# EAGLE schematic Resistor_Resistor (EAGLE 8.3.0), part 21 of 43
## Parts (continued)
R28698  10K  RESISTOR_0201  [0201]
R28699  10K  RESISTOR_0201  [0201]
R28700  10K  RESISTOR_0201  [0201]
R28701  10K  RESISTOR_0201  [0201]
R28702  10K  RESISTOR_0201  [0201]
R28703  10K  RESISTOR_0201  [0201]
R28704  10K  RESISTOR_0201  [0201]
R28705  10K  RESISTOR_0201  [0201]
R28706  10K  RESISTOR_0201  [0201]
R28707  10K  RESISTOR_0201  [0201]
R28708  10K  RESISTOR_0201  [0201]
R28709  10K  RESISTOR_0201  [0201]
R28710  10K  RESISTOR_0201  [0201]
R28711  10K  RESISTOR_0201  [0201]
R28712  10K  RESISTOR_0201  [0201]
R28713  10K  RESISTOR_0201  [0201]
R28714  10K  RESISTOR_0201  [0201]
R28715  10K  RESISTOR_0201  [0201]
R28716  10K  RESISTOR_0201  [0201]
R28717  10K  RESISTOR_0201  [0201]
R28718  10K  RESISTOR_0201  [0201]
R28719  10K  RESISTOR_0201  [0201]
R28720  10K  RESISTOR_0201  [0201]
R28721  10K  RESISTOR_0201  [0201]
R28722  10K  RESISTOR_0201  [0201]
R28723  10K  RESISTOR_0201  [0201]
R28724  10K  RESISTOR_0201  [0201]
R28725  10K  RESISTOR_0201  [0201]
R28726  10K  RESISTOR_0201  [0201]
R28727  10K  RESISTOR_0201  [0201]
R28728  10K  RESISTOR_0201  [0201]
R28729  10K  RESISTOR_0201  [0201]
R28730  10K  RESISTOR_0201  [0201]
R28731  10K  RESISTOR_0201  [0201]
R28732  10K  RESISTOR_0201  [0201]
R28733  10K  RESISTOR_0201  [0201]
R28734  10K  RESISTOR_0201  [0201]
R28735  10K  RESISTOR_0201  [0201]
R28736  10K  RESISTOR_0201  [0201]
R28737  10K  RESISTOR_0201  [0201]
R28738  10K  RESISTOR_0201  [0201]
R28739  10K  RESISTOR_0201  [0201]
R28740  10K  RESISTOR_0201  [0201]
R28741  10K  RESISTOR_0201  [0201]
R28742  10K  RESISTOR_0201  [0201]
R28743  10K  RESISTOR_0201  [0201]
R28744  10K  RESISTOR_0201  [0201]
R28745  10K  RESISTOR_0201  [0201]
R28746  10K  RESISTOR_0201  [0201]
R28747  10K  RESISTOR_0201  [0201]
R28748  10K  RESISTOR_0201  [0201]
R28749  10K  RESISTOR_0201  [0201]
R28750  10K  RESISTOR_0201  [0201]
R28751  10K  RESISTOR_0201  [0201]
R28752  10K  RESISTOR_0201  [0201]
R28753  10K  RESISTOR_0201  [0201]
R28754  10K  RESISTOR_0201  [0201]
R28755  10K  RESISTOR_0201  [0201]
R28756  10K  RESISTOR_0201  [0201]
R28757  10K  RESISTOR_0201  [0201]
R28758  10K  RESISTOR_0201  [0201]
R28759  10K  RESISTOR_0201  [0201]
R28760  10K  RESISTOR_0201  [0201]
R28761  10K  RESISTOR_0201  [0201]
R28762  10K  RESISTOR_0201  [0201]
R28763  10K  RESISTOR_0201  [0201]
R28764  10K  RESISTOR_0201  [0201]
R28765  10K  RESISTOR_0201  [0201]
R28766  10K  RESISTOR_0201  [0201]
R28767  10K  RESISTOR_0201  [0201]
R28768  10K  RESISTOR_0201  [0201]
R28769  10K  RESISTOR_0201  [0201]
R28770  10K  RESISTOR_0201  [0201]
R28771  10K  RESISTOR_0201  [0201]
R28772  10K  RESISTOR_0201  [0201]
R28773  10K  RESISTOR_0201  [0201]
R28774  10K  RESISTOR_0201  [0201]
R28775  10K  RESISTOR_0201  [0201]
R28776  10K  RESISTOR_0201  [0201]
R28777  10K  RESISTOR_0201  [0201]
R28778  10K  RESISTOR_0201  [0201]
R28779  10K  RESISTOR_0201  [0201]
R28780  10K  RESISTOR_0201  [0201]
R28781  10K  RESISTOR_0201  [0201]
R28782  10K  RESISTOR_0201  [0201]
R28783  10K  RESISTOR_0201  [0201]
R28784  10K  RESISTOR_0201  [0201]
R28785  10K  RESISTOR_0201  [0201]
R28786  10K  RESISTOR_0201  [0201]
R28787  10K  RESISTOR_0201  [0201]
R28788  10K  RESISTOR_0201  [0201]
R28789  10K  RESISTOR_0201  [0201]
R28790  10K  RESISTOR_0201  [0201]
R28791  10K  RESISTOR_0201  [0201]
R28792  10K  RESISTOR_0201  [0201]
R28793  10K  RESISTOR_0201  [0201]
R28794  10K  RESISTOR_0201  [0201]
R28795  10K  RESISTOR_0201  [0201]
R28796  10K  RESISTOR_0201  [0201]
R28797  10K  RESISTOR_0201  [0201]
R28798  10K  RESISTOR_0201  [0201]
R28799  10K  RESISTOR_0201  [0201]
R28800  10K  RESISTOR_0201  [0201]
R28801  10K  RESISTOR_0201  [0201]
R28802  10K  RESISTOR_0201  [0201]
R28803  10K  RESISTOR_0201  [0201]
R28804  10K  RESISTOR_0201  [0201]
R28805  10K  RESISTOR_0201  [0201]
R28806  10K  RESISTOR_0201  [0201]
R28807  10K  RESISTOR_0201  [0201]
R28808  10K  RESISTOR_0201  [0201]
R28809  10K  RESISTOR_0201  [0201]
R28810  10K  RESISTOR_0201  [0201]
R28811  10K  RESISTOR_0201  [0201]
R28812  10K  RESISTOR_0201  [0201]
R28813  10K  RESISTOR_0201  [0201]
R28814  10K  RESISTOR_0201  [0201]
R28815  10K  RESISTOR_0201  [0201]
R28816  10K  RESISTOR_0201  [0201]
R28817  10K  RESISTOR_0201  [0201]
R28818  10K  RESISTOR_0201  [0201]
R28819  10K  RESISTOR_0201  [0201]
R28820  10K  RESISTOR_0201  [0201]
R28821  10K  RESISTOR_0201  [0201]
R28822  10K  RESISTOR_0201  [0201]
R28823  10K  RESISTOR_0201  [0201]
R28824  10K  RESISTOR_0201  [0201]
R28825  10K  RESISTOR_0201  [0201]
R28826  10K  RESISTOR_0201  [0201]
R28827  10K  RESISTOR_0201  [0201]
R28828  10K  RESISTOR_0201  [0201]
R28829  10K  RESISTOR_0201  [0201]
R28830  10K  RESISTOR_0201  [0201]
R28831  10K  RESISTOR_0201  [0201]
R28832  10K  RESISTOR_0201  [0201]
R28833  10K  RESISTOR_0201  [0201]
R28834  10K  RESISTOR_0201  [0201]
R28835  10K  RESISTOR_0201  [0201]
R28836  10K  RESISTOR_0201  [0201]
R28837  10K  RESISTOR_0201  [0201]
R28838  10K  RESISTOR_0201  [0201]
R28839  10K  RESISTOR_0201  [0201]
R28840  10K  RESISTOR_0201  [0201]
R28841  10K  RESISTOR_0201  [0201]
R28842  10K  RESISTOR_0201  [0201]
R28843  10K  RESISTOR_0201  [0201]
R28844  10K  RESISTOR_0201  [0201]
R28845  10K  RESISTOR_0201  [0201]
R28846  10K  RESISTOR_0201  [0201]
R28847  10K  RESISTOR_0201  [0201]
R28848  10K  RESISTOR_0201  [0201]
R28849  10K  RESISTOR_0201  [0201]
R28850  10K  RESISTOR_0201  [0201]
R28851  10K  RESISTOR_0201  [0201]
R28852  10K  RESISTOR_0201  [0201]
R28853  10K  RESISTOR_0201  [0201]
R28854  10K  RESISTOR_0201  [0201]
R28855  10K  RESISTOR_0201  [0201]
R28856  10K  RESISTOR_0201  [0201]
R28857  10K  RESISTOR_0201  [0201]
R28858  10K  RESISTOR_0201  [0201]
R28859  10K  RESISTOR_0201  [0201]
R28860  10K  RESISTOR_0201  [0201]
R28861  10K  RESISTOR_0201  [0201]
R28862  10K  RESISTOR_0201  [0201]
R28863  10K  RESISTOR_0201  [0201]
R28864  10K  RESISTOR_0201  [0201]
R28865  10K  RESISTOR_0201  [0201]
R28866  10K  RESISTOR_0201  [0201]
R28867  10K  RESISTOR_0201  [0201]
R28868  10K  RESISTOR_0201  [0201]
R28869  10K  RESISTOR_0201  [0201]
R28870  10K  RESISTOR_0201  [0201]
R28871  10K  RESISTOR_0201  [0201]
R28872  10K  RESISTOR_0201  [0201]
R28873  10K  RESISTOR_0201  [0201]
R28874  10K  RESISTOR_0201  [0201]
R28875  10K  RESISTOR_0201  [0201]
R28876  10K  RESISTOR_0201  [0201]
R28877  10K  RESISTOR_0201  [0201]
R28878  10K  RESISTOR_0201  [0201]
R28879  10K  RESISTOR_0201  [0201]
R28880  10K  RESISTOR_0201  [0201]
R28881  10K  RESISTOR_0201  [0201]
R28882  10K  RESISTOR_0201  [0201]
R28883  10K  RESISTOR_0201  [0201]
R28884  10K  RESISTOR_0201  [0201]
R28885  10K  RESISTOR_0201  [0201]
R28886  10K  RESISTOR_0201  [0201]
R28887  10K  RESISTOR_0201  [0201]
R28888  10K  RESISTOR_0201  [0201]
R28889  10K  RESISTOR_0201  [0201]
R28890  10K  RESISTOR_0201  [0201]
R28891  10K  RESISTOR_0201  [0201]
R28892  10K  RESISTOR_0201  [0201]
R28893  10K  RESISTOR_0201  [0201]
R28894  10K  RESISTOR_0201  [0201]
R28895  10K  RESISTOR_0201  [0201]
R28896  10K  RESISTOR_0201  [0201]
R28897  10K  RESISTOR_0201  [0201]
R28898  10K  RESISTOR_0201  [0201]
R28899  10K  RESISTOR_0201  [0201]
R28900  10K  RESISTOR_0201  [0201]
R28901  10K  RESISTOR_0201  [0201]
R28902  10K  RESISTOR_0201  [0201]
R28903  10K  RESISTOR_0201  [0201]
R28904  10K  RESISTOR_0201  [0201]
R28905  10K  RESISTOR_0201  [0201]
R28906  10K  RESISTOR_0201  [0201]
R28907  10K  RESISTOR_0201  [0201]
R28908  10K  RESISTOR_0201  [0201]
R28909  10K  RESISTOR_0201  [0201]
R28910  10K  RESISTOR_0201  [0201]
R28911  10K  RESISTOR_0201  [0201]
R28912  10K  RESISTOR_0201  [0201]
R28913  10K  RESISTOR_0201  [0201]
R28914  10K  RESISTOR_0201  [0201]
R28915  10K  RESISTOR_0201  [0201]
R28916  10K  RESISTOR_0201  [0201]
R28917  10K  RESISTOR_0201  [0201]
R28918  10K  RESISTOR_0201  [0201]
R28919  10K  RESISTOR_0201  [0201]
R28920  10K  RESISTOR_0201  [0201]
R28921  10K  RESISTOR_0201  [0201]
R28922  10K  RESISTOR_0201  [0201]
R28923  10K  RESISTOR_0201  [0201]
R28924  10K  RESISTOR_0201  [0201]
R28925  10K  RESISTOR_0201  [0201]
R28926  10K  RESISTOR_0201  [0201]
R28927  10K  RESISTOR_0201  [0201]
R28928  10K  RESISTOR_0201  [0201]
R28929  10K  RESISTOR_0201  [0201]
R28930  10K  RESISTOR_0201  [0201]
R28931  10K  RESISTOR_0201  [0201]
R28932  10K  RESISTOR_0201  [0201]
R28933  10K  RESISTOR_0201  [0201]
R28934  10K  RESISTOR_0201  [0201]
R28935  10K  RESISTOR_0201  [0201]
R28936  10K  RESISTOR_0201  [0201]
R28937  10K  RESISTOR_0201  [0201]
R28938  10K  RESISTOR_0201  [0201]
R28939  10K  RESISTOR_0201  [0201]
R28940  10K  RESISTOR_0201  [0201]
R28941  10K  RESISTOR_0201  [0201]
R28942  10K  RESISTOR_0201  [0201]
R28943  10K  RESISTOR_0201  [0201]
R28944  10K  RESISTOR_0201  [0201]
R28945  10K  RESISTOR_0201  [0201]
R28946  10K  RESISTOR_0201  [0201]
R28947  10K  RESISTOR_0201  [0201]
R28948  10K  RESISTOR_0201  [0201]
R28949  10K  RESISTOR_0201  [0201]
R28950  10K  RESISTOR_0201  [0201]
R28951  10K  RESISTOR_0201  [0201]
R28952  10K  RESISTOR_0201  [0201]
R28953  10K  RESISTOR_0201  [0201]
R28954  10K  RESISTOR_0201  [0201]
R28955  10K  RESISTOR_0201  [0201]
R28956  10K  RESISTOR_0201  [0201]
R28957  10K  RESISTOR_0201  [0201]
R28958  10K  RESISTOR_0201  [0201]
R28959  10K  RESISTOR_0201  [0201]
R28960  10K  RESISTOR_0201  [0201]
R28961  10K  RESISTOR_0201  [0201]
R28962  10K  RESISTOR_0201  [0201]
R28963  10K  RESISTOR_0201  [0201]
R28964  10K  RESISTOR_0201  [0201]
R28965  10K  RESISTOR_0201  [0201]
R28966  10K  RESISTOR_0201  [0201]
R28967  10K  RESISTOR_0201  [0201]
R28968  10K  RESISTOR_0201  [0201]
R28969  10K  RESISTOR_0201  [0201]
R28970  10K  RESISTOR_0201  [0201]
R28971  10K  RESISTOR_0201  [0201]
R28972  10K  RESISTOR_0201  [0201]
R28973  10K  RESISTOR_0201  [0201]
R28974  10K  RESISTOR_0201  [0201]
R28975  10K  RESISTOR_0201  [0201]
R28976  10K  RESISTOR_0201  [0201]
R28977  10K  RESISTOR_0201  [0201]
R28978  10K  RESISTOR_0201  [0201]
R28979  10K  RESISTOR_0201  [0201]
R28980  10K  RESISTOR_0201  [0201]
R28981  10K  RESISTOR_0201  [0201]
R28982  10K  RESISTOR_0201  [0201]
R28983  10K  RESISTOR_0201  [0201]
R28984  10K  RESISTOR_0201  [0201]
R28985  10K  RESISTOR_0201  [0201]
R28986  10K  RESISTOR_0201  [0201]
R28987  10K  RESISTOR_0201  [0201]
R28988  10K  RESISTOR_0201  [0201]
R28989  10K  RESISTOR_0201  [0201]
R28990  10K  RESISTOR_0201  [0201]
R28991  10K  RESISTOR_0201  [0201]
R28992  10K  RESISTOR_0201  [0201]
R28993  10K  RESISTOR_0201  [0201]
R28994  10K  RESISTOR_0201  [0201]
R28995  10K  RESISTOR_0201  [0201]
R28996  10K  RESISTOR_0201  [0201]
R28997  10K  RESISTOR_0201  [0201]
R28998  10K  RESISTOR_0201  [0201]
R28999  10K  RESISTOR_0201  [0201]
R29000  10K  RESISTOR_0201  [0201]
R29001  10K  RESISTOR_0201  [0201]
R29002  10K  RESISTOR_0201  [0201]
R29003  10K  RESISTOR_0201  [0201]
R29004  10K  RESISTOR_0201  [0201]
R29005  10K  RESISTOR_0201  [0201]
R29006  10K  RESISTOR_0201  [0201]
R29007  10K  RESISTOR_0201  [0201]
R29008  10K  RESISTOR_0201  [0201]
R29009  10K  RESISTOR_0201  [0201]
R29010  10K  RESISTOR_0201  [0201]
R29011  10K  RESISTOR_0201  [0201]
R29012  10K  RESISTOR_0201  [0201]
R29013  10K  RESISTOR_0201  [0201]
R29014  10K  RESISTOR_0201  [0201]
R29015  10K  RESISTOR_0201  [0201]
R29016  10K  RESISTOR_0201  [0201]
R29017  10K  RESISTOR_0201  [0201]
R29018  10K  RESISTOR_0201  [0201]
R29019  10K  RESISTOR_0201  [0201]
R29020  10K  RESISTOR_0201  [0201]
R29021  10K  RESISTOR_0201  [0201]
R29022  10K  RESISTOR_0201  [0201]
R29023  10K  RESISTOR_0201  [0201]
R29024  10K  RESISTOR_0201  [0201]
R29025  10K  RESISTOR_0201  [0201]
R29026  10K  RESISTOR_0201  [0201]
R29027  10K  RESISTOR_0201  [0201]
R29028  10K  RESISTOR_0201  [0201]
R29029  10K  RESISTOR_0201  [0201]
R29030  10K  RESISTOR_0201  [0201]
R29031  10K  RESISTOR_0201  [0201]
R29032  10K  RESISTOR_0201  [0201]
R29033  10K  RESISTOR_0201  [0201]
R29034  10K  RESISTOR_0201  [0201]
R29035  10K  RESISTOR_0201  [0201]
R29036  10K  RESISTOR_0201  [0201]
R29037  10K  RESISTOR_0201  [0201]
R29038  10K  RESISTOR_0201  [0201]
R29039  10K  RESISTOR_0201  [0201]
R29040  10K  RESISTOR_0201  [0201]
R29041  10K  RESISTOR_0201  [0201]
R29042  10K  RESISTOR_0201  [0201]
R29043  10K  RESISTOR_0201  [0201]
R29044  10K  RESISTOR_0201  [0201]
R29045  10K  RESISTOR_0201  [0201]
R29046  10K  RESISTOR_0201  [0201]
R29047  10K  RESISTOR_0201  [0201]
R29048  10K  RESISTOR_0201  [0201]
R29049  10K  RESISTOR_0201  [0201]
R29050  10K  RESISTOR_0201  [0201]
R29051  10K  RESISTOR_0201  [0201]
R29052  10K  RESISTOR_0201  [0201]
R29053  10K  RESISTOR_0201  [0201]
R29054  10K  RESISTOR_0201  [0201]
R29055  10K  RESISTOR_0201  [0201]
R29056  10K  RESISTOR_0201  [0201]
R29057  10K  RESISTOR_0201  [0201]
R29058  10K  RESISTOR_0201  [0201]
R29059  10K  RESISTOR_0201  [0201]
R29060  10K  RESISTOR_0201  [0201]
R29061  10K  RESISTOR_0201  [0201]
R29062  10K  RESISTOR_0201  [0201]
R29063  10K  RESISTOR_0201  [0201]
R29064  10K  RESISTOR_0201  [0201]
R29065  10K  RESISTOR_0201  [0201]
R29066  10K  RESISTOR_0201  [0201]
R29067  10K  RESISTOR_0201  [0201]
R29068  10K  RESISTOR_0201  [0201]
R29069  10K  RESISTOR_0201  [0201]
R29070  10K  RESISTOR_0201  [0201]
R29071  10K  RESISTOR_0201  [0201]
R29072  10K  RESISTOR_0201  [0201]
R29073  10K  RESISTOR_0201  [0201]
R29074  10K  RESISTOR_0201  [0201]
R29075  10K  RESISTOR_0201  [0201]
R29076  10K  RESISTOR_0201  [0201]
R29077  10K  RESISTOR_0201  [0201]
R29078  10K  RESISTOR_0201  [0201]
R29079  10K  RESISTOR_0201  [0201]
R29080  10K  RESISTOR_0201  [0201]
R29081  10K  RESISTOR_0201  [0201]
R29082  10K  RESISTOR_0201  [0201]
R29083  10K  RESISTOR_0201  [0201]
R29084  10K  RESISTOR_0201  [0201]
R29085  10K  RESISTOR_0201  [0201]
R29086  10K  RESISTOR_0201  [0201]
R29087  10K  RESISTOR_0201  [0201]
R29088  10K  RESISTOR_0201  [0201]
R29089  10K  RESISTOR_0201  [0201]
R29090  10K  RESISTOR_0201  [0201]
R29091  10K  RESISTOR_0201  [0201]
R29092  10K  RESISTOR_0201  [0201]
R29093  10K  RESISTOR_0201  [0201]
R29094  10K  RESISTOR_0201  [0201]
R29095  10K  RESISTOR_0201  [0201]
R29096  10K  RESISTOR_0201  [0201]
R29097  10K  RESISTOR_0201  [0201]
R29098  10K  RESISTOR_0201  [0201]
R29099  10K  RESISTOR_0201  [0201]
R29100  10K  RESISTOR_0201  [0201]
R29101  10K  RESISTOR_0201  [0201]
R29102  10K  RESISTOR_0201  [0201]
R29103  10K  RESISTOR_0201  [0201]
R29104  10K  RESISTOR_0201  [0201]
R29105  10K  RESISTOR_0201  [0201]
R29106  10K  RESISTOR_0201  [0201]
R29107  10K  RESISTOR_0201  [0201]
R29108  10K  RESISTOR_0201  [0201]
R29109  10K  RESISTOR_0201  [0201]
R29110  10K  RESISTOR_0201  [0201]
R29111  10K  RESISTOR_0201  [0201]
R29112  10K  RESISTOR_0201  [0201]
R29113  10K  RESISTOR_0201  [0201]
R29114  10K  RESISTOR_0201  [0201]
R29115  10K  RESISTOR_0201  [0201]
R29116  10K  RESISTOR_0201  [0201]
R29117  10K  RESISTOR_0201  [0201]
R29118  10K  RESISTOR_0201  [0201]
R29119  10K  RESISTOR_0201  [0201]
R29120  10K  RESISTOR_0201  [0201]
R29121  10K  RESISTOR_0201  [0201]
R29122  10K  RESISTOR_0201  [0201]
R29123  10K  RESISTOR_0201  [0201]
R29124  10K  RESISTOR_0201  [0201]
R29125  10K  RESISTOR_0201  [0201]
R29126  10K  RESISTOR_0201  [0201]
R29127  10K  RESISTOR_0201  [0201]
R29128  10K  RESISTOR_0201  [0201]
R29129  10K  RESISTOR_0201  [0201]
R29130  10K  RESISTOR_0201  [0201]
R29131  10K  RESISTOR_0201  [0201]
R29132  10K  RESISTOR_0201  [0201]
R29133  10K  RESISTOR_0201  [0201]
R29134  10K  RESISTOR_0201  [0201]
R29135  10K  RESISTOR_0201  [0201]
R29136  10K  RESISTOR_0201  [0201]
R29137  10K  RESISTOR_0201  [0201]
R29138  10K  RESISTOR_0201  [0201]
R29139  10K  RESISTOR_0201  [0201]
R29140  10K  RESISTOR_0201  [0201]
R29141  10K  RESISTOR_0201  [0201]
R29142  10K  RESISTOR_0201  [0201]
R29143  10K  RESISTOR_0201  [0201]
R29144  10K  RESISTOR_0201  [0201]
R29145  10K  RESISTOR_0201  [0201]
R29146  10K  RESISTOR_0201  [0201]
R29147  10K  RESISTOR_0201  [0201]
R29148  10K  RESISTOR_0201  [0201]
R29149  10K  RESISTOR_0201  [0201]
R29150  10K  RESISTOR_0201  [0201]
R29151  10K  RESISTOR_0201  [0201]
R29152  10K  RESISTOR_0201  [0201]
R29153  10K  RESISTOR_0201  [0201]
R29154  10K  RESISTOR_0201  [0201]
R29155  10K  RESISTOR_0201  [0201]
R29156  10K  RESISTOR_0201  [0201]
R29157  10K  RESISTOR_0201  [0201]
R29158  10K  RESISTOR_0201  [0201]
R29159  10K  RESISTOR_0201  [0201]
R29160  10K  RESISTOR_0201  [0201]
R29161  10K  RESISTOR_0201  [0201]
R29162  10K  RESISTOR_0201  [0201]
R29163  10K  RESISTOR_0201  [0201]
R29164  10K  RESISTOR_0201  [0201]
R29165  10K  RESISTOR_0201  [0201]
R29166  10K  RESISTOR_0201  [0201]
R29167  10K  RESISTOR_0201  [0201]
R29168  10K  RESISTOR_0201  [0201]
R29169  10K  RESISTOR_0201  [0201]
R29170  10K  RESISTOR_0201  [0201]
R29171  10K  RESISTOR_0201  [0201]
R29172  10K  RESISTOR_0201  [0201]
R29173  10K  RESISTOR_0201  [0201]
R29174  10K  RESISTOR_0201  [0201]
R29175  10K  RESISTOR_0201  [0201]
R29176  10K  RESISTOR_0201  [0201]
R29177  10K  RESISTOR_0201  [0201]
R29178  10K  RESISTOR_0201  [0201]
R29179  10K  RESISTOR_0201  [0201]
R29180  10K  RESISTOR_0201  [0201]
R29181  10K  RESISTOR_0201  [0201]
R29182  10K  RESISTOR_0201  [0201]
R29183  10K  RESISTOR_0201  [0201]
R29184  10K  RESISTOR_0201  [0201]
R29185  10K  RESISTOR_0201  [0201]
R29186  10K  RESISTOR_0201  [0201]
R29187  10K  RESISTOR_0201  [0201]
R29188  10K  RESISTOR_0201  [0201]
R29189  10K  RESISTOR_0201  [0201]
R29190  10K  RESISTOR_0201  [0201]
R29191  10K  RESISTOR_0201  [0201]
R29192  10K  RESISTOR_0201  [0201]
R29193  10K  RESISTOR_0201  [0201]
R29194  10K  RESISTOR_0201  [0201]
R29195  10K  RESISTOR_0201  [0201]
R29196  10K  RESISTOR_0201  [0201]
R29197  10K  RESISTOR_0201  [0201]
R29198  10K  RESISTOR_0201  [0201]
R29199  10K  RESISTOR_0201  [0201]
R29200  10K  RESISTOR_0201  [0201]
R29201  10K  RESISTOR_0201  [0201]
R29202  10K  RESISTOR_0201  [0201]
R29203  10K  RESISTOR_0201  [0201]
R29204  10K  RESISTOR_0201  [0201]
R29205  10K  RESISTOR_0201  [0201]
R29206  10K  RESISTOR_0201  [0201]
R29207  10K  RESISTOR_0201  [0201]
R29208  10K  RESISTOR_0201  [0201]
R29209  10K  RESISTOR_0201  [0201]
R29210  10K  RESISTOR_0201  [0201]
R29211  10K  RESISTOR_0201  [0201]
R29212  10K  RESISTOR_0201  [0201]
R29213  10K  RESISTOR_0201  [0201]
R29214  10K  RESISTOR_0201  [0201]
R29215  10K  RESISTOR_0201  [0201]
R29216  10K  RESISTOR_0201  [0201]
R29217  10K  RESISTOR_0201  [0201]
R29218  10K  RESISTOR_0201  [0201]
R29219  10K  RESISTOR_0201  [0201]
R29220  10K  RESISTOR_0201  [0201]
R29221  10K  RESISTOR_0201  [0201]
R29222  10K  RESISTOR_0201  [0201]
R29223  10K  RESISTOR_0201  [0201]
R29224  10K  RESISTOR_0201  [0201]
R29225  10K  RESISTOR_0201  [0201]
R29226  10K  RESISTOR_0201  [0201]
R29227  10K  RESISTOR_0201  [0201]
R29228  10K  RESISTOR_0201  [0201]
R29229  10K  RESISTOR_0201  [0201]
R29230  10K  RESISTOR_0201  [0201]
R29231  10K  RESISTOR_0201  [0201]
R29232  10K  RESISTOR_0201  [0201]
R29233  10K  RESISTOR_0201  [0201]
R29234  10K  RESISTOR_0201  [0201]
R29235  10K  RESISTOR_0201  [0201]
R29236  10K  RESISTOR_0201  [0201]
R29237  10K  RESISTOR_0201  [0201]
R29238  10K  RESISTOR_0201  [0201]
R29239  10K  RESISTOR_0201  [0201]
R29240  10K  RESISTOR_0201  [0201]
R29241  10K  RESISTOR_0201  [0201]
R29242  10K  RESISTOR_0201  [0201]
R29243  10K  RESISTOR_0201  [0201]
R29244  10K  RESISTOR_0201  [0201]
R29245  10K  RESISTOR_0201  [0201]
R29246  10K  RESISTOR_0201  [0201]
R29247  10K  RESISTOR_0201  [0201]
R29248  10K  RESISTOR_0201  [0201]
R29249  10K  RESISTOR_0201  [0201]
R29250  10K  RESISTOR_0201  [0201]
R29251  10K  RESISTOR_0201  [0201]
R29252  10K  RESISTOR_0201  [0201]
R29253  10K  RESISTOR_0201  [0201]
R29254  10K  RESISTOR_0201  [0201]
R29255  10K  RESISTOR_0201  [0201]
R29256  10K  RESISTOR_0201  [0201]
R29257  10K  RESISTOR_0201  [0201]
R29258  10K  RESISTOR_0201  [0201]
R29259  10K  RESISTOR_0201  [0201]
R29260  10K  RESISTOR_0201  [0201]
R29261  10K  RESISTOR_0201  [0201]
R29262  10K  RESISTOR_0201  [0201]
R29263  10K  RESISTOR_0201  [0201]
R29264  10K  RESISTOR_0201  [0201]
R29265  10K  RESISTOR_0201  [0201]
R29266  10K  RESISTOR_0201  [0201]
R29267  10K  RESISTOR_0201  [0201]
R29268  10K  RESISTOR_0201  [0201]
R29269  10K  RESISTOR_0201  [0201]
R29270  10K  RESISTOR_0201  [0201]
R29271  10K  RESISTOR_0201  [0201]
R29272  10K  RESISTOR_0201  [0201]
R29273  10K  RESISTOR_0201  [0201]
R29274  10K  RESISTOR_0201  [0201]
R29275  10K  RESISTOR_0201  [0201]
R29276  10K  RESISTOR_0201  [0201]
R29277  10K  RESISTOR_0201  [0201]
R29278  10K  RESISTOR_0201  [0201]
R29279  10K  RESISTOR_0201  [0201]
R29280  10K  RESISTOR_0201  [0201]
R29281  10K  RESISTOR_0201  [0201]
R29282  10K  RESISTOR_0201  [0201]
R29283  10K  RESISTOR_0201  [0201]
R29284  10K  RESISTOR_0201  [0201]
R29285  10K  RESISTOR_0201  [0201]
R29286  10K  RESISTOR_0201  [0201]
R29287  10K  RESISTOR_0201  [0201]
R29288  10K  RESISTOR_0201  [0201]
R29289  10K  RESISTOR_0201  [0201]
R29290  10K  RESISTOR_0201  [0201]
R29291  10K  RESISTOR_0201  [0201]
R29292  10K  RESISTOR_0201  [0201]
R29293  10K  RESISTOR_0201  [0201]
R29294  10K  RESISTOR_0201  [0201]
R29295  10K  RESISTOR_0201  [0201]
R29296  10K  RESISTOR_0201  [0201]
R29297  10K  RESISTOR_0201  [0201]
R29298  10K  RESISTOR_0201  [0201]
R29299  10K  RESISTOR_0201  [0201]
R29300  10K  RESISTOR_0201  [0201]
R29301  10K  RESISTOR_0201  [0201]
R29302  10K  RESISTOR_0201  [0201]
R29303  10K  RESISTOR_0201  [0201]
R29304  10K  RESISTOR_0201  [0201]
R29305  10K  RESISTOR_0201  [0201]
R29306  10K  RESISTOR_0201  [0201]
R29307  10K  RESISTOR_0201  [0201]
R29308  10K  RESISTOR_0201  [0201]
R29309  10K  RESISTOR_0201  [0201]
R29310  10K  RESISTOR_0201  [0201]
R29311  10K  RESISTOR_0201  [0201]
R29312  10K  RESISTOR_0201  [0201]
R29313  10K  RESISTOR_0201  [0201]
R29314  10K  RESISTOR_0201  [0201]
R29315  10K  RESISTOR_0201  [0201]
R29316  10K  RESISTOR_0201  [0201]
R29317  10K  RESISTOR_0201  [0201]
R29318  10K  RESISTOR_0201  [0201]
R29319  10K  RESISTOR_0201  [0201]
R29320  10K  RESISTOR_0201  [0201]
R29321  10K  RESISTOR_0201  [0201]
R29322  10K  RESISTOR_0201  [0201]
R29323  10K  RESISTOR_0201  [0201]
R29324  10K  RESISTOR_0201  [0201]
R29325  10K  RESISTOR_0201  [0201]
R29326  10K  RESISTOR_0201  [0201]
R29327  10K  RESISTOR_0201  [0201]
R29328  10K  RESISTOR_0201  [0201]
R29329  10K  RESISTOR_0201  [0201]
R29330  10K  RESISTOR_0201  [0201]
R29331  10K  RESISTOR_0201  [0201]
R29332  10K  RESISTOR_0201  [0201]
R29333  10K  RESISTOR_0201  [0201]
R29334  10K  RESISTOR_0201  [0201]
R29335  10K  RESISTOR_0201  [0201]
R29336  10K  RESISTOR_0201  [0201]
R29337  10K  RESISTOR_0201  [0201]
R29338  10K  RESISTOR_0201  [0201]
R29339  10K  RESISTOR_0201  [0201]
R29340  10K  RESISTOR_0201  [0201]
R29341  10K  RESISTOR_0201  [0201]
R29342  10K  RESISTOR_0201  [0201]
R29343  10K  RESISTOR_0201  [0201]
R29344  10K  RESISTOR_0201  [0201]
R29345  10K  RESISTOR_0201  [0201]
R29346  10K  RESISTOR_0201  [0201]
R29347  10K  RESISTOR_0201  [0201]
R29348  10K  RESISTOR_0201  [0201]
R29349  10K  RESISTOR_0201  [0201]
R29350  10K  RESISTOR_0201  [0201]
R29351  10K  RESISTOR_0201  [0201]
R29352  10K  RESISTOR_0201  [0201]
R29353  10K  RESISTOR_0201  [0201]
R29354  10K  RESISTOR_0201  [0201]
R29355  10K  RESISTOR_0201  [0201]
R29356  10K  RESISTOR_0201  [0201]
R29357  10K  RESISTOR_0201  [0201]
R29358  10K  RESISTOR_0201  [0201]
R29359  10K  RESISTOR_0201  [0201]
R29360  10K  RESISTOR_0201  [0201]
R29361  10K  RESISTOR_0201  [0201]
R29362  10K  RESISTOR_0201  [0201]
R29363  10K  RESISTOR_0201  [0201]
R29364  10K  RESISTOR_0201  [0201]
R29365  10K  RESISTOR_0201  [0201]
R29366  10K  RESISTOR_0201  [0201]
R29367  10K  RESISTOR_0201  [0201]
R29368  10K  RESISTOR_0201  [0201]
R29369  10K  RESISTOR_0201  [0201]
R29370  10K  RESISTOR_0201  [0201]
R29371  10K  RESISTOR_0201  [0201]
R29372  10K  RESISTOR_0201  [0201]
R29373  10K  RESISTOR_0201  [0201]
R29374  10K  RESISTOR_0201  [0201]
R29375  10K  RESISTOR_0201  [0201]
R29376  10K  RESISTOR_0201  [0201]
R29377  10K  RESISTOR_0201  [0201]
R29378  10K  RESISTOR_0201  [0201]
R29379  10K  RESISTOR_0201  [0201]
R29380  10K  RESISTOR_0201  [0201]
R29381  10K  RESISTOR_0201  [0201]
R29382  10K  RESISTOR_0201  [0201]
R29383  10K  RESISTOR_0201  [0201]
R29384  10K  RESISTOR_0201  [0201]
R29385  10K  RESISTOR_0201  [0201]
R29386  10K  RESISTOR_0201  [0201]
R29387  10K  RESISTOR_0201  [0201]
R29388  10K  RESISTOR_0201  [0201]
R29389  10K  RESISTOR_0201  [0201]
R29390  10K  RESISTOR_0201  [0201]
R29391  10K  RESISTOR_0201  [0201]
R29392  10K  RESISTOR_0201  [0201]
R29393  10K  RESISTOR_0201  [0201]
R29394  10K  RESISTOR_0201  [0201]
R29395  10K  RESISTOR_0201  [0201]
R29396  10K  RESISTOR_0201  [0201]
R29397  10K  RESISTOR_0201  [0201]
R29398  10K  RESISTOR_0201  [0201]
R29399  10K  RESISTOR_0201  [0201]
R29400  10K  RESISTOR_0201  [0201]
R29401  10K  RESISTOR_0201  [0201]
R29402  10K  RESISTOR_0201  [0201]
R29403  10K  RESISTOR_0201  [0201]
R29404  10K  RESISTOR_0201  [0201]
R29405  10K  RESISTOR_0201  [0201]
R29406  10K  RESISTOR_0201  [0201]
R29407  10K  RESISTOR_0201  [0201]
R29408  10K  RESISTOR_0201  [0201]
R29409  10K  RESISTOR_0201  [0201]
R29410  10K  RESISTOR_0201  [0201]
R29411  10K  RESISTOR_0201  [0201]
R29412  10K  RESISTOR_0201  [0201]
R29413  10K  RESISTOR_0201  [0201]
R29414  10K  RESISTOR_0201  [0201]
R29415  10K  RESISTOR_0201  [0201]
R29416  10K  RESISTOR_0201  [0201]
R29417  10K  RESISTOR_0201  [0201]
R29418  10K  RESISTOR_0201  [0201]
R29419  10K  RESISTOR_0201  [0201]
R29420  10K  RESISTOR_0201  [0201]
R29421  10K  RESISTOR_0201  [0201]
R29422  10K  RESISTOR_0201  [0201]
R29423  10K  RESISTOR_0201  [0201]
R29424  10K  RESISTOR_0201  [0201]
R29425  10K  RESISTOR_0201  [0201]
R29426  10K  RESISTOR_0201  [0201]
R29427  10K  RESISTOR_0201  [0201]
R29428  10K  RESISTOR_0201  [0201]
R29429  10K  RESISTOR_0201  [0201]
R29430  10K  RESISTOR_0201  [0201]
R29431  10K  RESISTOR_0201  [0201]
R29432  10K  RESISTOR_0201  [0201]
R29433  10K  RESISTOR_0201  [0201]
R29434  10K  RESISTOR_0201  [0201]
R29435  10K  RESISTOR_0201  [0201]
R29436  10K  RESISTOR_0201  [0201]
R29437  10K  RESISTOR_0201  [0201]
R29438  10K  RESISTOR_0201  [0201]
R29439  10K  RESISTOR_0201  [0201]
R29440  10K  RESISTOR_0201  [0201]
R29441  10K  RESISTOR_0201  [0201]
R29442  10K  RESISTOR_0201  [0201]
R29443  10K  RESISTOR_0201  [0201]
R29444  10K  RESISTOR_0201  [0201]
R29445  10K  RESISTOR_0201  [0201]
R29446  10K  RESISTOR_0201  [0201]
R29447  10K  RESISTOR_0201  [0201]
R29448  10K  RESISTOR_0201  [0201]
R29449  10K  RESISTOR_0201  [0201]
R29450  10K  RESISTOR_0201  [0201]
R29451  10K  RESISTOR_0201  [0201]
R29452  10K  RESISTOR_0201  [0201]
R29453  10K  RESISTOR_0201  [0201]
R29454  10K  RESISTOR_0201  [0201]
R29455  10K  RESISTOR_0201  [0201]
R29456  10K  RESISTOR_0201  [0201]
R29457  10K  RESISTOR_0201  [0201]
R29458  10K  RESISTOR_0201  [0201]
R29459  10K  RESISTOR_0201  [0201]
R29460  10K  RESISTOR_0201  [0201]
R29461  10K  RESISTOR_0201  [0201]
R29462  10K  RESISTOR_0201  [0201]
R29463  10K  RESISTOR_0201  [0201]
R29464  10K  RESISTOR_0201  [0201]
R29465  10K  RESISTOR_0201  [0201]
R29466  10K  RESISTOR_0201  [0201]
R29467  10K  RESISTOR_0201  [0201]
R29468  10K  RESISTOR_0201  [0201]
R29469  10K  RESISTOR_0201  [0201]
R29470  10K  RESISTOR_0201  [0201]
R29471  10K  RESISTOR_0201  [0201]
R29472  10K  RESISTOR_0201  [0201]
R29473  10K  RESISTOR_0201  [0201]
R29474  10K  RESISTOR_0201  [0201]
R29475  10K  RESISTOR_0201  [0201]
R29476  10K  RESISTOR_0201  [0201]
R29477  10K  RESISTOR_0201  [0201]
R29478  10K  RESISTOR_0201  [0201]
R29479  10K  RESISTOR_0201  [0201]
R29480  10K  RESISTOR_0201  [0201]
R29481  10K  RESISTOR_0201  [0201]
R29482  10K  RESISTOR_0201  [0201]
R29483  10K  RESISTOR_0201  [0201]
R29484  10K  RESISTOR_0201  [0201]
R29485  10K  RESISTOR_0201  [0201]
R29486  10K  RESISTOR_0201  [0201]
R29487  10K  RESISTOR_0201  [0201]
R29488  10K  RESISTOR_0201  [0201]
R29489  10K  RESISTOR_0201  [0201]
R29490  10K  RESISTOR_0201  [0201]
R29491  10K  RESISTOR_0201  [0201]
R29492  10K  RESISTOR_0201  [0201]
R29493  10K  RESISTOR_0201  [0201]
R29494  10K  RESISTOR_0201  [0201]
R29495  10K  RESISTOR_0201  [0201]
R29496  10K  RESISTOR_0201  [0201]
R29497  10K  RESISTOR_0201  [0201]
R29498  10K  RESISTOR_0201  [0201]
R29499  10K  RESISTOR_0201  [0201]
R29500  10K  RESISTOR_0201  [0201]
R29501  10K  RESISTOR_0201  [0201]
R29502  10K  RESISTOR_0201  [0201]
R29503  10K  RESISTOR_0201  [0201]
R29504  10K  RESISTOR_0201  [0201]
R29505  10K  RESISTOR_0201  [0201]
R29506  10K  RESISTOR_0201  [0201]
R29507  10K  RESISTOR_0201  [0201]
R29508  10K  RESISTOR_0201  [0201]
R29509  10K  RESISTOR_0201  [0201]
R29510  10K  RESISTOR_0201  [0201]
R29511  10K  RESISTOR_0201  [0201]
R29512  10K  RESISTOR_0201  [0201]
R29513  10K  RESISTOR_0201  [0201]
R29514  10K  RESISTOR_0201  [0201]
R29515  10K  RESISTOR_0201  [0201]
R29516  10K  RESISTOR_0201  [0201]
R29517  10K  RESISTOR_0201  [0201]
R29518  10K  RESISTOR_0201  [0201]
R29519  10K  RESISTOR_0201  [0201]
R29520  10K  RESISTOR_0201  [0201]
R29521  10K  RESISTOR_0201  [0201]
R29522  10K  RESISTOR_0201  [0201]
R29523  10K  RESISTOR_0201  [0201]
R29524  10K  RESISTOR_0201  [0201]
R29525  10K  RESISTOR_0201  [0201]
R29526  10K  RESISTOR_0201  [0201]
R29527  10K  RESISTOR_0201  [0201]
R29528  10K  RESISTOR_0201  [0201]
R29529  10K  RESISTOR_0201  [0201]
R29530  10K  RESISTOR_0201  [0201]
R29531  10K  RESISTOR_0201  [0201]
R29532  10K  RESISTOR_0201  [0201]
R29533  10K  RESISTOR_0201  [0201]
R29534  10K  RESISTOR_0201  [0201]
R29535  10K  RESISTOR_0201  [0201]
R29536  10K  RESISTOR_0201  [0201]
R29537  10K  RESISTOR_0201  [0201]
R29538  10K  RESISTOR_0201  [0201]
R29539  10K  RESISTOR_0201  [0201]
R29540  10K  RESISTOR_0201  [0201]
R29541  10K  RESISTOR_0201  [0201]
R29542  10K  RESISTOR_0201  [0201]
R29543  10K  RESISTOR_0201  [0201]
R29544  10K  RESISTOR_0201  [0201]
R29545  10K  RESISTOR_0201  [0201]
R29546  10K  RESISTOR_0201  [0201]
R29547  10K  RESISTOR_0201  [0201]
R29548  10K  RESISTOR_0201  [0201]
R29549  10K  RESISTOR_0201  [0201]
R29550  10K  RESISTOR_0201  [0201]
R29551  10K  RESISTOR_0201  [0201]
R29552  10K  RESISTOR_0201  [0201]
R29553  10K  RESISTOR_0201  [0201]
R29554  10K  RESISTOR_0201  [0201]
R29555  10K  RESISTOR_0201  [0201]
R29556  10K  RESISTOR_0201  [0201]
R29557  10K  RESISTOR_0201  [0201]
R29558  10K  RESISTOR_0201  [0201]
R29559  10K  RESISTOR_0201  [0201]
R29560  10K  RESISTOR_0201  [0201]
R29561  10K  RESISTOR_0201  [0201]
R29562  10K  RESISTOR_0201  [0201]
R29563  10K  RESISTOR_0201  [0201]
R29564  10K  RESISTOR_0201  [0201]
R29565  10K  RESISTOR_0201  [0201]
R29566  10K  RESISTOR_0201  [0201]
R29567  10K  RESISTOR_0201  [0201]
R29568  10K  RESISTOR_0201  [0201]
R29569  10K  RESISTOR_0201  [0201]
R29570  10K  RESISTOR_0201  [0201]
R29571  10K  RESISTOR_0201  [0201]
R29572  10K  RESISTOR_0201  [0201]
R29573  10K  RESISTOR_0201  [0201]
R29574  10K  RESISTOR_0201  [0201]
R29575  10K  RESISTOR_0201  [0201]
R29576  10K  RESISTOR_0201  [0201]
R29577  10K  RESISTOR_0201  [0201]
R29578  10K  RESISTOR_0201  [0201]
R29579  10K  RESISTOR_0201  [0201]
R29580  10K  RESISTOR_0201  [0201]
R29581  10K  RESISTOR_0201  [0201]
R29582  10K  RESISTOR_0201  [0201]
R29583  10K  RESISTOR_0201  [0201]
R29584  10K  RESISTOR_0201  [0201]
R29585  10K  RESISTOR_0201  [0201]
R29586  10K  RESISTOR_0201  [0201]
R29587  10K  RESISTOR_0201  [0201]
R29588  10K  RESISTOR_0201  [0201]
R29589  10K  RESISTOR_0201  [0201]
R29590  10K  RESISTOR_0201  [0201]
R29591  10K  RESISTOR_0201  [0201]
R29592  10K  RESISTOR_0201  [0201]
R29593  10K  RESISTOR_0201  [0201]
R29594  10K  RESISTOR_0201  [0201]
R29595  10K  RESISTOR_0201  [0201]
R29596  10K  RESISTOR_0201  [0201]
R29597  10K  RESISTOR_0201  [0201]
R29598  10K  RESISTOR_0201  [0201]
R29599  10K  RESISTOR_0201  [0201]
R29600  10K  RESISTOR_0201  [0201]
R29601  10K  RESISTOR_0201  [0201]
R29602  10K  RESISTOR_0201  [0201]
R29603  10K  RESISTOR_0201  [0201]
R29604  10K  RESISTOR_0201  [0201]
R29605  10K  RESISTOR_0201  [0201]
R29606  10K  RESISTOR_0201  [0201]
R29607  10K  RESISTOR_0201  [0201]
R29608  10K  RESISTOR_0201  [0201]
R29609  10K  RESISTOR_0201  [0201]
R29610  10K  RESISTOR_0201  [0201]
R29611  10K  RESISTOR_0201  [0201]
R29612  10K  RESISTOR_0201  [0201]
R29613  10K  RESISTOR_0201  [0201]
R29614  10K  RESISTOR_0201  [0201]
R29615  10K  RESISTOR_0201  [0201]
R29616  10K  RESISTOR_0201  [0201]
R29617  10K  RESISTOR_0201  [0201]
R29618  10K  RESISTOR_0201  [0201]
R29619  10K  RESISTOR_0201  [0201]
R29620  10K  RESISTOR_0201  [0201]
R29621  10K  RESISTOR_0201  [0201]
R29622  10K  RESISTOR_0201  [0201]
R29623  10K  RESISTOR_0201  [0201]
R29624  10K  RESISTOR_0201  [0201]
R29625  10K  RESISTOR_0201  [0201]
R29626  10K  RESISTOR_0201  [0201]
R29627  10K  RESISTOR_0201  [0201]
R29628  10K  RESISTOR_0201  [0201]
R29629  10K  RESISTOR_0201  [0201]
R29630  10K  RESISTOR_0201  [0201]
R29631  10K  RESISTOR_0201  [0201]
R29632  10K  RESISTOR_0201  [0201]
R29633  10K  RESISTOR_0201  [0201]
R29634  10K  RESISTOR_0201  [0201]
R29635  10K  RESISTOR_0201  [0201]
R29636  10K  RESISTOR_0201  [0201]
R29637  10K  RESISTOR_0201  [0201]
R29638  10K  RESISTOR_0201  [0201]
R29639  10K  RESISTOR_0201  [0201]
R29640  10K  RESISTOR_0201  [0201]
R29641  10K  RESISTOR_0201  [0201]
R29642  10K  RESISTOR_0201  [0201]
R29643  10K  RESISTOR_0201  [0201]
R29644  10K  RESISTOR_0201  [0201]
R29645  10K  RESISTOR_0201  [0201]
R29646  10K  RESISTOR_0201  [0201]
R29647  10K  RESISTOR_0201  [0201]
R29648  10K  RESISTOR_0201  [0201]
R29649  10K  RESISTOR_0201  [0201]
R29650  10K  RESISTOR_0201  [0201]
R29651  10K  RESISTOR_0201  [0201]
R29652  10K  RESISTOR_0201  [0201]
R29653  10K  RESISTOR_0201  [0201]
R29654  10K  RESISTOR_0201  [0201]
R29655  10K  RESISTOR_0201  [0201]
R29656  10K  RESISTOR_0201  [0201]
R29657  10K  RESISTOR_0201  [0201]
R29658  10K  RESISTOR_0201  [0201]
R29659  10K  RESISTOR_0201  [0201]
R29660  10K  RESISTOR_0201  [0201]
R29661  10K  RESISTOR_0201  [0201]
R29662  10K  RESISTOR_0201  [0201]
R29663  10K  RESISTOR_0201  [0201]
R29664  10K  RESISTOR_0201  [0201]
R29665  10K  RESISTOR_0201  [0201]
R29666  10K  RESISTOR_0201  [0201]
R29667  10K  RESISTOR_0201  [0201]
R29668  10K  RESISTOR_0201  [0201]
R29669  10K  RESISTOR_0201  [0201]
R29670  10K  RESISTOR_0201  [0201]
R29671  10K  RESISTOR_0201  [0201]
R29672  10K  RESISTOR_0201  [0201]
R29673  10K  RESISTOR_0201  [0201]
R29674  10K  RESISTOR_0201  [0201]
R29675  10K  RESISTOR_0201  [0201]
R29676  10K  RESISTOR_0201  [0201]
R29677  10K  RESISTOR_0201  [0201]
R29678  10K  RESISTOR_0201  [0201]
R29679  10K  RESISTOR_0201  [0201]
R29680  10K  RESISTOR_0201  [0201]
R29681  10K  RESISTOR_0201  [0201]
R29682  10K  RESISTOR_0201  [0201]
R29683  10K  RESISTOR_0201  [0201]
R29684  10K  RESISTOR_0201  [0201]
R29685  10K  RESISTOR_0201  [0201]
R29686  10K  RESISTOR_0201  [0201]
R29687  10K  RESISTOR_0201  [0201]
R29688  10K  RESISTOR_0201  [0201]
R29689  10K  RESISTOR_0201  [0201]
R29690  10K  RESISTOR_0201  [0201]
R29691  10K  RESISTOR_0201  [0201]
R29692  10K  RESISTOR_0201  [0201]
R29693  10K  RESISTOR_0201  [0201]
R29694  10K  RESISTOR_0201  [0201]
R29695  10K  RESISTOR_0201  [0201]
R29696  10K  RESISTOR_0201  [0201]
R29697  10K  RESISTOR_0201  [0201]
R29698  10K  RESISTOR_0201  [0201]
R29699  10K  RESISTOR_0201  [0201]
R29700  10K  RESISTOR_0201  [0201]
R29701  10K  RESISTOR_0201  [0201]
R29702  10K  RESISTOR_0201  [0201]
R29703  10K  RESISTOR_0201  [0201]
R29704  10K  RESISTOR_0201  [0201]
R29705  10K  RESISTOR_0201  [0201]
R29706  10K  RESISTOR_0201  [0201]
R29707  10K  RESISTOR_0201  [0201]
R29708  10K  RESISTOR_0201  [0201]
R29709  10K  RESISTOR_0201  [0201]
R29710  10K  RESISTOR_0201  [0201]
R29711  10K  RESISTOR_0201  [0201]
R29712  10K  RESISTOR_0201  [0201]
R29713  10K  RESISTOR_0201  [0201]
R29714  10K  RESISTOR_0201  [0201]
R29715  10K  RESISTOR_0201  [0201]
R29716  10K  RESISTOR_0201  [0201]
R29717  10K  RESISTOR_0201  [0201]
R29718  10K  RESISTOR_0201  [0201]
R29719  10K  RESISTOR_0201  [0201]
R29720  10K  RESISTOR_0201  [0201]
R29721  10K  RESISTOR_0201  [0201]
R29722  10K  RESISTOR_0201  [0201]
R29723  10K  RESISTOR_0201  [0201]
R29724  10K  RESISTOR_0201  [0201]
R29725  10K  RESISTOR_0201  [0201]
R29726  10K  RESISTOR_0201  [0201]
R29727  10K  RESISTOR_0201  [0201]
R29728  10K  RESISTOR_0201  [0201]
R29729  10K  RESISTOR_0201  [0201]
R29730  10K  RESISTOR_0201  [0201]
R29731  10K  RESISTOR_0201  [0201]
R29732  10K  RESISTOR_0201  [0201]
R29733  10K  RESISTOR_0201  [0201]
R29734  10K  RESISTOR_0201  [0201]
R29735  10K  RESISTOR_0201  [0201]
R29736  10K  RESISTOR_0201  [0201]
R29737  10K  RESISTOR_0201  [0201]
R29738  10K  RESISTOR_0201  [0201]
R29739  10K  RESISTOR_0201  [0201]
R29740  10K  RESISTOR_0201  [0201]
R29741  10K  RESISTOR_0201  [0201]
R29742  10K  RESISTOR_0201  [0201]
R29743  10K  RESISTOR_0201  [0201]
R29744  10K  RESISTOR_0201  [0201]
R29745  10K  RESISTOR_0201  [0201]
R29746  10K  RESISTOR_0201  [0201]
R29747  10K  RESISTOR_0201  [0201]
R29748  10K  RESISTOR_0201  [0201]
R29749  10K  RESISTOR_0201  [0201]
R29750  10K  RESISTOR_0201  [0201]
R29751  10K  RESISTOR_0201  [0201]
R29752  10K  RESISTOR_0201  [0201]
R29753  10K  RESISTOR_0201  [0201]
R29754  10K  RESISTOR_0201  [0201]
R29755  10K  RESISTOR_0201  [0201]
R29756  10K  RESISTOR_0201  [0201]
R29757  10K  RESISTOR_0201  [0201]
R29758  10K  RESISTOR_0201  [0201]
R29759  10K  RESISTOR_0201  [0201]
R29760  10K  RESISTOR_0201  [0201]
R29761  10K  RESISTOR_0201  [0201]
R29762  10K  RESISTOR_0201  [0201]
R29763  10K  RESISTOR_0201  [0201]
R29764  10K  RESISTOR_0201  [0201]
R29765  10K  RESISTOR_0201  [0201]
R29766  10K  RESISTOR_0201  [0201]
R29767  10K  RESISTOR_0201  [0201]
R29768  10K  RESISTOR_0201  [0201]
R29769  10K  RESISTOR_0201  [0201]
R29770  10K  RESISTOR_0201  [0201]
R29771  10K  RESISTOR_0201  [0201]
R29772  10K  RESISTOR_0201  [0201]
R29773  10K  RESISTOR_0201  [0201]
R29774  10K  RESISTOR_0201  [0201]
R29775  10K  RESISTOR_0201  [0201]
R29776  10K  RESISTOR_0201  [0201]
R29777  10K  RESISTOR_0201  [0201]
R29778  10K  RESISTOR_0201  [0201]
R29779  10K  RESISTOR_0201  [0201]
R29780  10K  RESISTOR_0201  [0201]
R29781  10K  RESISTOR_0201  [0201]
R29782  10K  RESISTOR_0201  [0201]
R29783  10K  RESISTOR_0201  [0201]
R29784  10K  RESISTOR_0201  [0201]
R29785  10K  RESISTOR_0201  [0201]
R29786  10K  RESISTOR_0201  [0201]
R29787  10K  RESISTOR_0201  [0201]
R29788  10K  RESISTOR_0201  [0201]
R29789  10K  RESISTOR_0201  [0201]
R29790  10K  RESISTOR_0201  [0201]
R29791  10K  RESISTOR_0201  [0201]
R29792  10K  RESISTOR_0201  [0201]
R29793  10K  RESISTOR_0201  [0201]
R29794  10K  RESISTOR_0201  [0201]
R29795  10K  RESISTOR_0201  [0201]
R29796  10K  RESISTOR_0201  [0201]
R29797  10K  RESISTOR_0201  [0201]
R29798  10K  RESISTOR_0201  [0201]
R29799  10K  RESISTOR_0201  [0201]
R29800  10K  RESISTOR_0201  [0201]
R29801  10K  RESISTOR_0201  [0201]
R29802  10K  RESISTOR_0201  [0201]
R29803  10K  RESISTOR_0201  [0201]
R29804  10K  RESISTOR_0201  [0201]
R29805  10K  RESISTOR_0201  [0201]
R29806  10K  RESISTOR_0201  [0201]
R29807  10K  RESISTOR_0201  [0201]
R29808  10K  RESISTOR_0201  [0201]
R29809  10K  RESISTOR_0201  [0201]
R29810  10K  RESISTOR_0201  [0201]
R29811  10K  RESISTOR_0201  [0201]
R29812  10K  RESISTOR_0201  [0201]
R29813  10K  RESISTOR_0201  [0201]
R29814  10K  RESISTOR_0201  [0201]
R29815  10K  RESISTOR_0201  [0201]
R29816  10K  RESISTOR_0201  [0201]
R29817  10K  RESISTOR_0201  [0201]
R29818  10K  RESISTOR_0201  [0201]
R29819  10K  RESISTOR_0201  [0201]
R29820  10K  RESISTOR_0201  [0201]
R29821  10K  RESISTOR_0201  [0201]
R29822  10K  RESISTOR_0201  [0201]
R29823  10K  RESISTOR_0201  [0201]
R29824  10K  RESISTOR_0201  [0201]
R29825  10K  RESISTOR_0201  [0201]
R29826  10K  RESISTOR_0201  [0201]
R29827  10K  RESISTOR_0201  [0201]
R29828  10K  RESISTOR_0201  [0201]
R29829  10K  RESISTOR_0201  [0201]
R29830  10K  RESISTOR_0201  [0201]
R29831  10K  RESISTOR_0201  [0201]
R29832  10K  RESISTOR_0201  [0201]
R29833  10K  RESISTOR_0201  [0201]
R29834  10K  RESISTOR_0201  [0201]
R29835  10K  RESISTOR_0201  [0201]
R29836  10K  RESISTOR_0201  [0201]
R29837  10K  RESISTOR_0201  [0201]
R29838  10K  RESISTOR_0201  [0201]
R29839  10K  RESISTOR_0201  [0201]
R29840  10K  RESISTOR_0201  [0201]
R29841  10K  RESISTOR_0201  [0201]
R29842  10K  RESISTOR_0201  [0201]
R29843  10K  RESISTOR_0201  [0201]
R29844  10K  RESISTOR_0201  [0201]
R29845  10K  RESISTOR_0201  [0201]
R29846  10K  RESISTOR_0201  [0201]
R29847  10K  RESISTOR_0201  [0201]
R29848  10K  RESISTOR_0201  [0201]
R29849  10K  RESISTOR_0201  [0201]
R29850  10K  RESISTOR_0201  [0201]
R29851  10K  RESISTOR_0201  [0201]
R29852  10K  RESISTOR_0201  [0201]
R29853  10K  RESISTOR_0201  [0201]
R29854  10K  RESISTOR_0201  [0201]
R29855  10K  RESISTOR_0201  [0201]
R29856  10K  RESISTOR_0201  [0201]
R29857  10K  RESISTOR_0201  [0201]
R29858  10K  RESISTOR_0201  [0201]
R29859  10K  RESISTOR_0201  [0201]
R29860  10K  RESISTOR_0201  [0201]
R29861  10K  RESISTOR_0201  [0201]
R29862  10K  RESISTOR_0201  [0201]
R29863  10K  RESISTOR_0201  [0201]
R29864  10K  RESISTOR_0201  [0201]
R29865  10K  RESISTOR_0201  [0201]
R29866  10K  RESISTOR_0201  [0201]
R29867  10K  RESISTOR_0201  [0201]
R29868  10K  RESISTOR_0201  [0201]
R29869  10K  RESISTOR_0201  [0201]
R29870  10K  RESISTOR_0201  [0201]
R29871  10K  RESISTOR_0201  [0201]
R29872  10K  RESISTOR_0201  [0201]
R29873  10K  RESISTOR_0201  [0201]
R29874  10K  RESISTOR_0201  [0201]
R29875  10K  RESISTOR_0201  [0201]
R29876  10K  RESISTOR_0201  [0201]
R29877  10K  RESISTOR_0201  [0201]
R29878  10K  RESISTOR_0201  [0201]
R29879  10K  RESISTOR_0201  [0201]
R29880  10K  RESISTOR_0201  [0201]
R29881  10K  RESISTOR_0201  [0201]
R29882  10K  RESISTOR_0201  [0201]
R29883  10K  RESISTOR_0201  [0201]
R29884  10K  RESISTOR_0201  [0201]
R29885  10K  RESISTOR_0201  [0201]
R29886  10K  RESISTOR_0201  [0201]
R29887  10K  RESISTOR_0201  [0201]
R29888  10K  RESISTOR_0201  [0201]
R29889  10K  RESISTOR_0201  [0201]
R29890  10K  RESISTOR_0201  [0201]
R29891  10K  RESISTOR_0201  [0201]
R29892  10K  RESISTOR_0201  [0201]
R29893  10K  RESISTOR_0201  [0201]
R29894  10K  RESISTOR_0201  [0201]
R29895  10K  RESISTOR_0201  [0201]
R29896  10K  RESISTOR_0201  [0201]
R29897  10K  RESISTOR_0201  [0201]
R29898  10K  RESISTOR_0201  [0201]
R29899  10K  RESISTOR_0201  [0201]
R29900  10K  RESISTOR_0201  [0201]
R29901  10K  RESISTOR_0201  [0201]
R29902  10K  RESISTOR_0201  [0201]
R29903  10K  RESISTOR_0201  [0201]
R29904  10K  RESISTOR_0201  [0201]
R29905  10K  RESISTOR_0201  [0201]
R29906  10K  RESISTOR_0201  [0201]
R29907  10K  RESISTOR_0201  [0201]
R29908  10K  RESISTOR_0201  [0201]
R29909  10K  RESISTOR_0201  [0201]
R29910  10K  RESISTOR_0201  [0201]
R29911  10K  RESISTOR_0201  [0201]
R29912  10K  RESISTOR_0201  [0201]
R29913  10K  RESISTOR_0201  [0201]
R29914  10K  RESISTOR_0201  [0201]
R29915  10K  RESISTOR_0201  [0201]
R29916  10K  RESISTOR_0201  [0201]
R29917  10K  RESISTOR_0201  [0201]
R29918  10K  RESISTOR_0201  [0201]
R29919  10K  RESISTOR_0201  [0201]
R29920  10K  RESISTOR_0201  [0201]
R29921  10K  RESISTOR_0201  [0201]
R29922  10K  RESISTOR_0201  [0201]
R29923  10K  RESISTOR_0201  [0201]
R29924  10K  RESISTOR_0201  [0201]
R29925  10K  RESISTOR_0201  [0201]
R29926  10K  RESISTOR_0201  [0201]
R29927  10K  RESISTOR_0201  [0201]
R29928  10K  RESISTOR_0201  [0201]
R29929  10K  RESISTOR_0201  [0201]
R29930  10K  RESISTOR_0201  [0201]
R29931  10K  RESISTOR_0201  [0201]
R29932  10K  RESISTOR_0201  [0201]
R29933  10K  RESISTOR_0201  [0201]
R29934  10K  RESISTOR_0201  [0201]
R29935  10K  RESISTOR_0201  [0201]
R29936  10K  RESISTOR_0201  [0201]
R29937  10K  RESISTOR_0201  [0201]
R29938  10K  RESISTOR_0201  [0201]
R29939  10K  RESISTOR_0201  [0201]
R29940  10K  RESISTOR_0201  [0201]
R29941  10K  RESISTOR_0201  [0201]
R29942  10K  RESISTOR_0201  [0201]
R29943  10K  RESISTOR_0201  [0201]
R29944  10K  RESISTOR_0201  [0201]
R29945  10K  RESISTOR_0201  [0201]
R29946  10K  RESISTOR_0201  [0201]
R29947  10K  RESISTOR_0201  [0201]
R29948  10K  RESISTOR_0201  [0201]
R29949  10K  RESISTOR_0201  [0201]
R29950  10K  RESISTOR_0201  [0201]
R29951  10K  RESISTOR_0201  [0201]
R29952  10K  RESISTOR_0201  [0201]
R29953  10K  RESISTOR_0201  [0201]
R29954  10K  RESISTOR_0201  [0201]
R29955  10K  RESISTOR_0201  [0201]
R29956  10K  RESISTOR_0201  [0201]
R29957  10K  RESISTOR_0201  [0201]
R29958  10K  RESISTOR_0201  [0201]
R29959  10K  RESISTOR_0201  [0201]
R29960  10K  RESISTOR_0201  [0201]
R29961  10K  RESISTOR_0201  [0201]
R29962  10K  RESISTOR_0201  [0201]
R29963  10K  RESISTOR_0201  [0201]
R29964  10K  RESISTOR_0201  [0201]
R29965  10K  RESISTOR_0201  [0201]
R29966  10K  RESISTOR_0201  [0201]
R29967  10K  RESISTOR_0201  [0201]
R29968  10K  RESISTOR_0201  [0201]
R29969  10K  RESISTOR_0201  [0201]
R29970  10K  RESISTOR_0201  [0201]
R29971  10K  RESISTOR_0201  [0201]
R29972  10K  RESISTOR_0201  [0201]
R29973  10K  RESISTOR_0201  [0201]
R29974  10K  RESISTOR_0201  [0201]
R29975  10K  RESISTOR_0201  [0201]
R29976  10K  RESISTOR_0201  [0201]
R29977  10K  RESISTOR_0201  [0201]
R29978  10K  RESISTOR_0201  [0201]
R29979  10K  RESISTOR_0201  [0201]
R29980  10K  RESISTOR_0201  [0201]
R29981  10K  RESISTOR_0201  [0201]
R29982  10K  RESISTOR_0201  [0201]
R29983  10K  RESISTOR_0201  [0201]
R29984  10K  RESISTOR_0201  [0201]
R29985  10K  RESISTOR_0201  [0201]
R29986  10K  RESISTOR_0201  [0201]
R29987  10K  RESISTOR_0201  [0201]
R29988  10K  RESISTOR_0201  [0201]
R29989  10K  RESISTOR_0201  [0201]
R29990  10K  RESISTOR_0201  [0201]
R29991  10K  RESISTOR_0201  [0201]
R29992  10K  RESISTOR_0201  [0201]
R29993  10K  RESISTOR_0201  [0201]
R29994  10K  RESISTOR_0201  [0201]
R29995  10K  RESISTOR_0201  [0201]
R29996  10K  RESISTOR_0201  [0201]
R29997  10K  RESISTOR_0201  [0201]
R29998  10K  RESISTOR_0201  [0201]
R29999  10K  RESISTOR_0201  [0201]
R30000  10K  RESISTOR_0201  [0201]
R30001  10K  RESISTOR_0201  [0201]
R30002  10K  RESISTOR_0201  [0201]
R30003  10K  RESISTOR_0201  [0201]
R30004  10K  RESISTOR_0201  [0201]
R30005  10K  RESISTOR_0201  [0201]
R30006  10K  RESISTOR_0201  [0201]
R30007  10K  RESISTOR_0201  [0201]
R30008  10K  RESISTOR_0201  [0201]
R30009  10K  RESISTOR_0201  [0201]
R30010  10K  RESISTOR_0201  [0201]
R30011  10K  RESISTOR_0201  [0201]
R30012  10K  RESISTOR_0201  [0201]
R30013  10K  RESISTOR_0201  [0201]
R30014  10K  RESISTOR_0201  [0201]
R30015  10K  RESISTOR_0201  [0201]
R30016  10K  RESISTOR_0201  [0201]
R30017  10K  RESISTOR_0201  [0201]
R30018  10K  RESISTOR_0201  [0201]
R30019  10K  RESISTOR_0201  [0201]
R30020  10K  RESISTOR_0201  [0201]
R30021  10K  RESISTOR_0201  [0201]
R30022  10K  RESISTOR_0201  [0201]
R30023  10K  RESISTOR_0201  [0201]
R30024  10K  RESISTOR_0201  [0201]
R30025  10K  RESISTOR_0201  [0201]
R30026  10K  RESISTOR_0201  [0201]
R30027  10K  RESISTOR_0201  [0201]
R30028  10K  RESISTOR_0201  [0201]
R30029  10K  RESISTOR_0201  [0201]
R30030  10K  RESISTOR_0201  [0201]
R30031  10K  RESISTOR_0201  [0201]
R30032  10K  RESISTOR_0201  [0201]
R30033  10K  RESISTOR_0201  [0201]
R30034  10K  RESISTOR_0201  [0201]
R30035  10K  RESISTOR_0201  [0201]
R30036  10K  RESISTOR_0201  [0201]
R30037  10K  RESISTOR_0201  [0201]
R30038  10K  RESISTOR_0201  [0201]
R30039  10K  RESISTOR_0201  [0201]
R30040  10K  RESISTOR_0201  [0201]
R30041  10K  RESISTOR_0201  [0201]
R30042  10K  RESISTOR_0201  [0201]
R30043  10K  RESISTOR_0201  [0201]
R30044  10K  RESISTOR_0201  [0201]
R30045  10K  RESISTOR_0201  [0201]
R30046  10K  RESISTOR_0201  [0201]
R30047  10K  RESISTOR_0201  [0201]
R30048  10K  RESISTOR_0201  [0201]
R30049  10K  RESISTOR_0201  [0201]
R30050  10K  RESISTOR_0201  [0201]
R30051  10K  RESISTOR_0201  [0201]
R30052  10K  RESISTOR_0201  [0201]
R30053  10K  RESISTOR_0201  [0201]
R30054  10K  RESISTOR_0201  [0201]
R30055  10K  RESISTOR_0201  [0201]
R30056  10K  RESISTOR_0201  [0201]
R30057  10K  RESISTOR_0201  [0201]
R30058  10K  RESISTOR_0201  [0201]
R30059  10K  RESISTOR_0201  [0201]
R30060  10K  RESISTOR_0201  [0201]
R30061  10K  RESISTOR_0201  [0201]
R30062  10K  RESISTOR_0201  [0201]
R30063  10K  RESISTOR_0201  [0201]
R30064  10K  RESISTOR_0201  [0201]
R30065  10K  RESISTOR_0201  [0201]
R30066  10K  RESISTOR_0201  [0201]
R30067  10K  RESISTOR_0201  [0201]
R30068  10K  RESISTOR_0201  [0201]
R30069  10K  RESISTOR_0201  [0201]
R30070  10K  RESISTOR_0201  [0201]
R30071  10K  RESISTOR_0201  [0201]
R30072  10K  RESISTOR_0201  [0201]
R30073  10K  RESISTOR_0201  [0201]
R30074  10K  RESISTOR_0201  [0201]
R30075  10K  RESISTOR_0201  [0201]
R30076  10K  RESISTOR_0201  [0201]
R30077  10K  RESISTOR_0201  [0201]
R30078  10K  RESISTOR_0201  [0201]
R30079  10K  RESISTOR_0201  [0201]
R30080  10K  RESISTOR_0201  [0201]
R30081  10K  RESISTOR_0201  [0201]
R30082  10K  RESISTOR_0201  [0201]
R30083  10K  RESISTOR_0201  [0201]
R30084  10K  RESISTOR_0201  [0201]
R30085  10K  RESISTOR_0201  [0201]
R30086  10K  RESISTOR_0201  [0201]
R30087  10K  RESISTOR_0201  [0201]
R30088  10K  RESISTOR_0201  [0201]
R30089  10K  RESISTOR_0201  [0201]
R30090  10K  RESISTOR_0201  [0201]
R30091  10K  RESISTOR_0201  [0201]
R30092  10K  RESISTOR_0201  [0201]
R30093  10K  RESISTOR_0201  [0201]
R30094  10K  RESISTOR_0201  [0201]
R30095  10K  RESISTOR_0201  [0201]
R30096  10K  RESISTOR_0201  [0201]
R30097  10K  RESISTOR_0201  [0201]
R30098  10K  RESISTOR_0201  [0201]
R30099  10K  RESISTOR_0201  [0201]
R30100  10K  RESISTOR_0201  [0201]
R30101  10K  RESISTOR_0201  [0201]
R30102  10K  RESISTOR_0201  [0201]
R30103  10K  RESISTOR_0201  [0201]
R30104  10K  RESISTOR_0201  [0201]
R30105  10K  RESISTOR_0201  [0201]
R30106  10K  RESISTOR_0201  [0201]
R30107  10K  RESISTOR_0201  [0201]
R30108  10K  RESISTOR_0201  [0201]
R30109  10K  RESISTOR_0201  [0201]
R30110  10K  RESISTOR_0201  [0201]
R30111  10K  RESISTOR_0201  [0201]
R30112  10K  RESISTOR_0201  [0201]
R30113  10K  RESISTOR_0201  [0201]
R30114  10K  RESISTOR_0201  [0201]
R30115  10K  RESISTOR_0201  [0201]
R30116  10K  RESISTOR_0201  [0201]
R30117  10K  RESISTOR_0201  [0201]